# Altium schematic sheet fpga-rx.SchDoc
size D; CompanyName: Brinton Engineering, LLC; Address1: 3479 Edison Way; Address2: Menlo Park CA 94025; Address3: +1 (877) 778-8435; Address4: brintonengineering.com; DocumentNumber: 40; Revision: 1; SheetNumber: 40; SheetTotal: 50
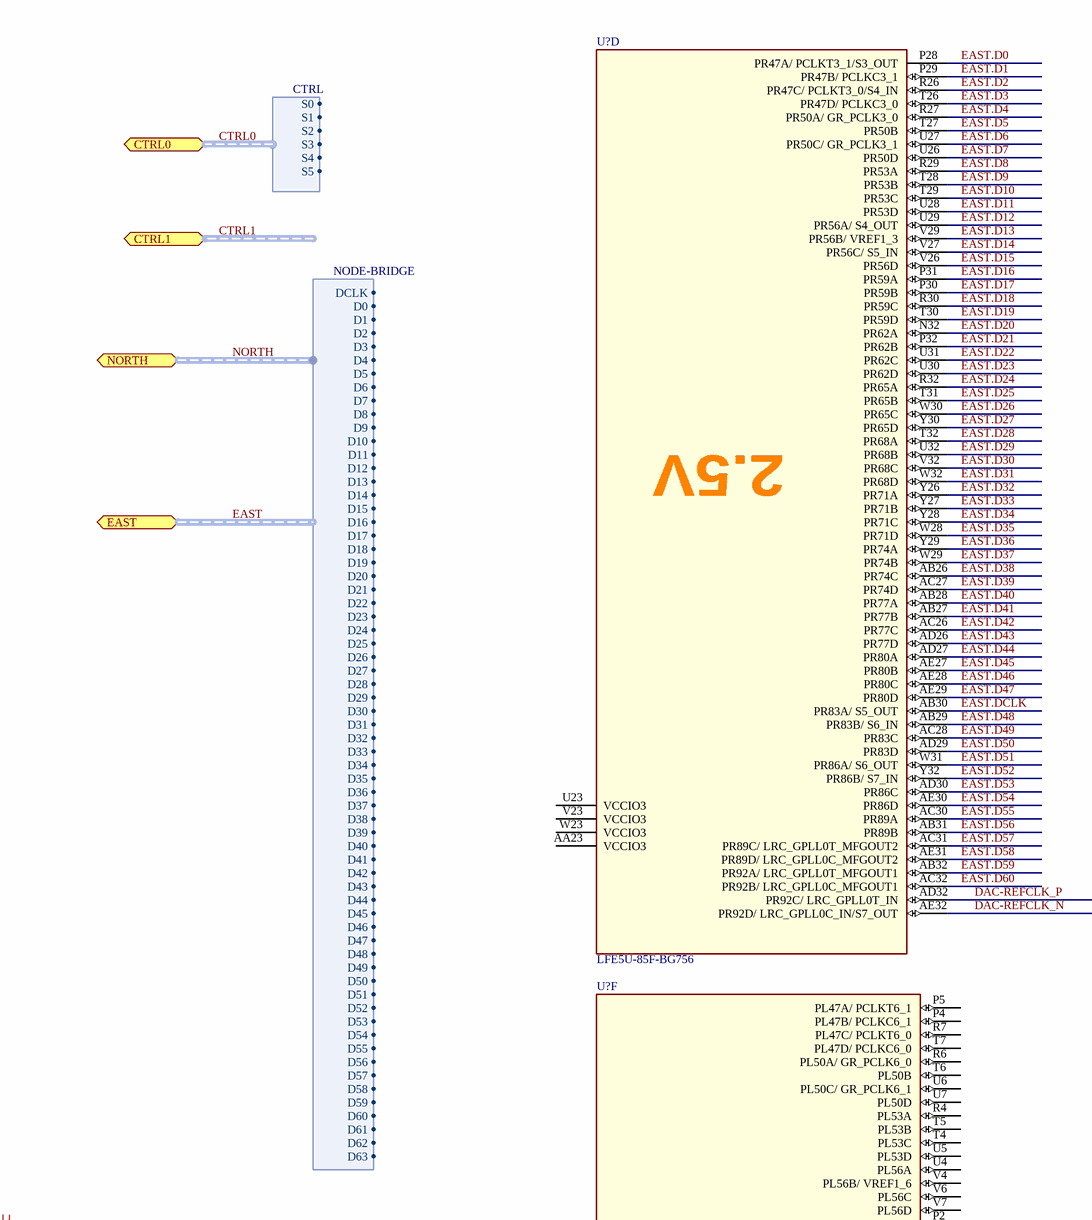
[diagram p0: fpga-rx.SchDoc, top left]
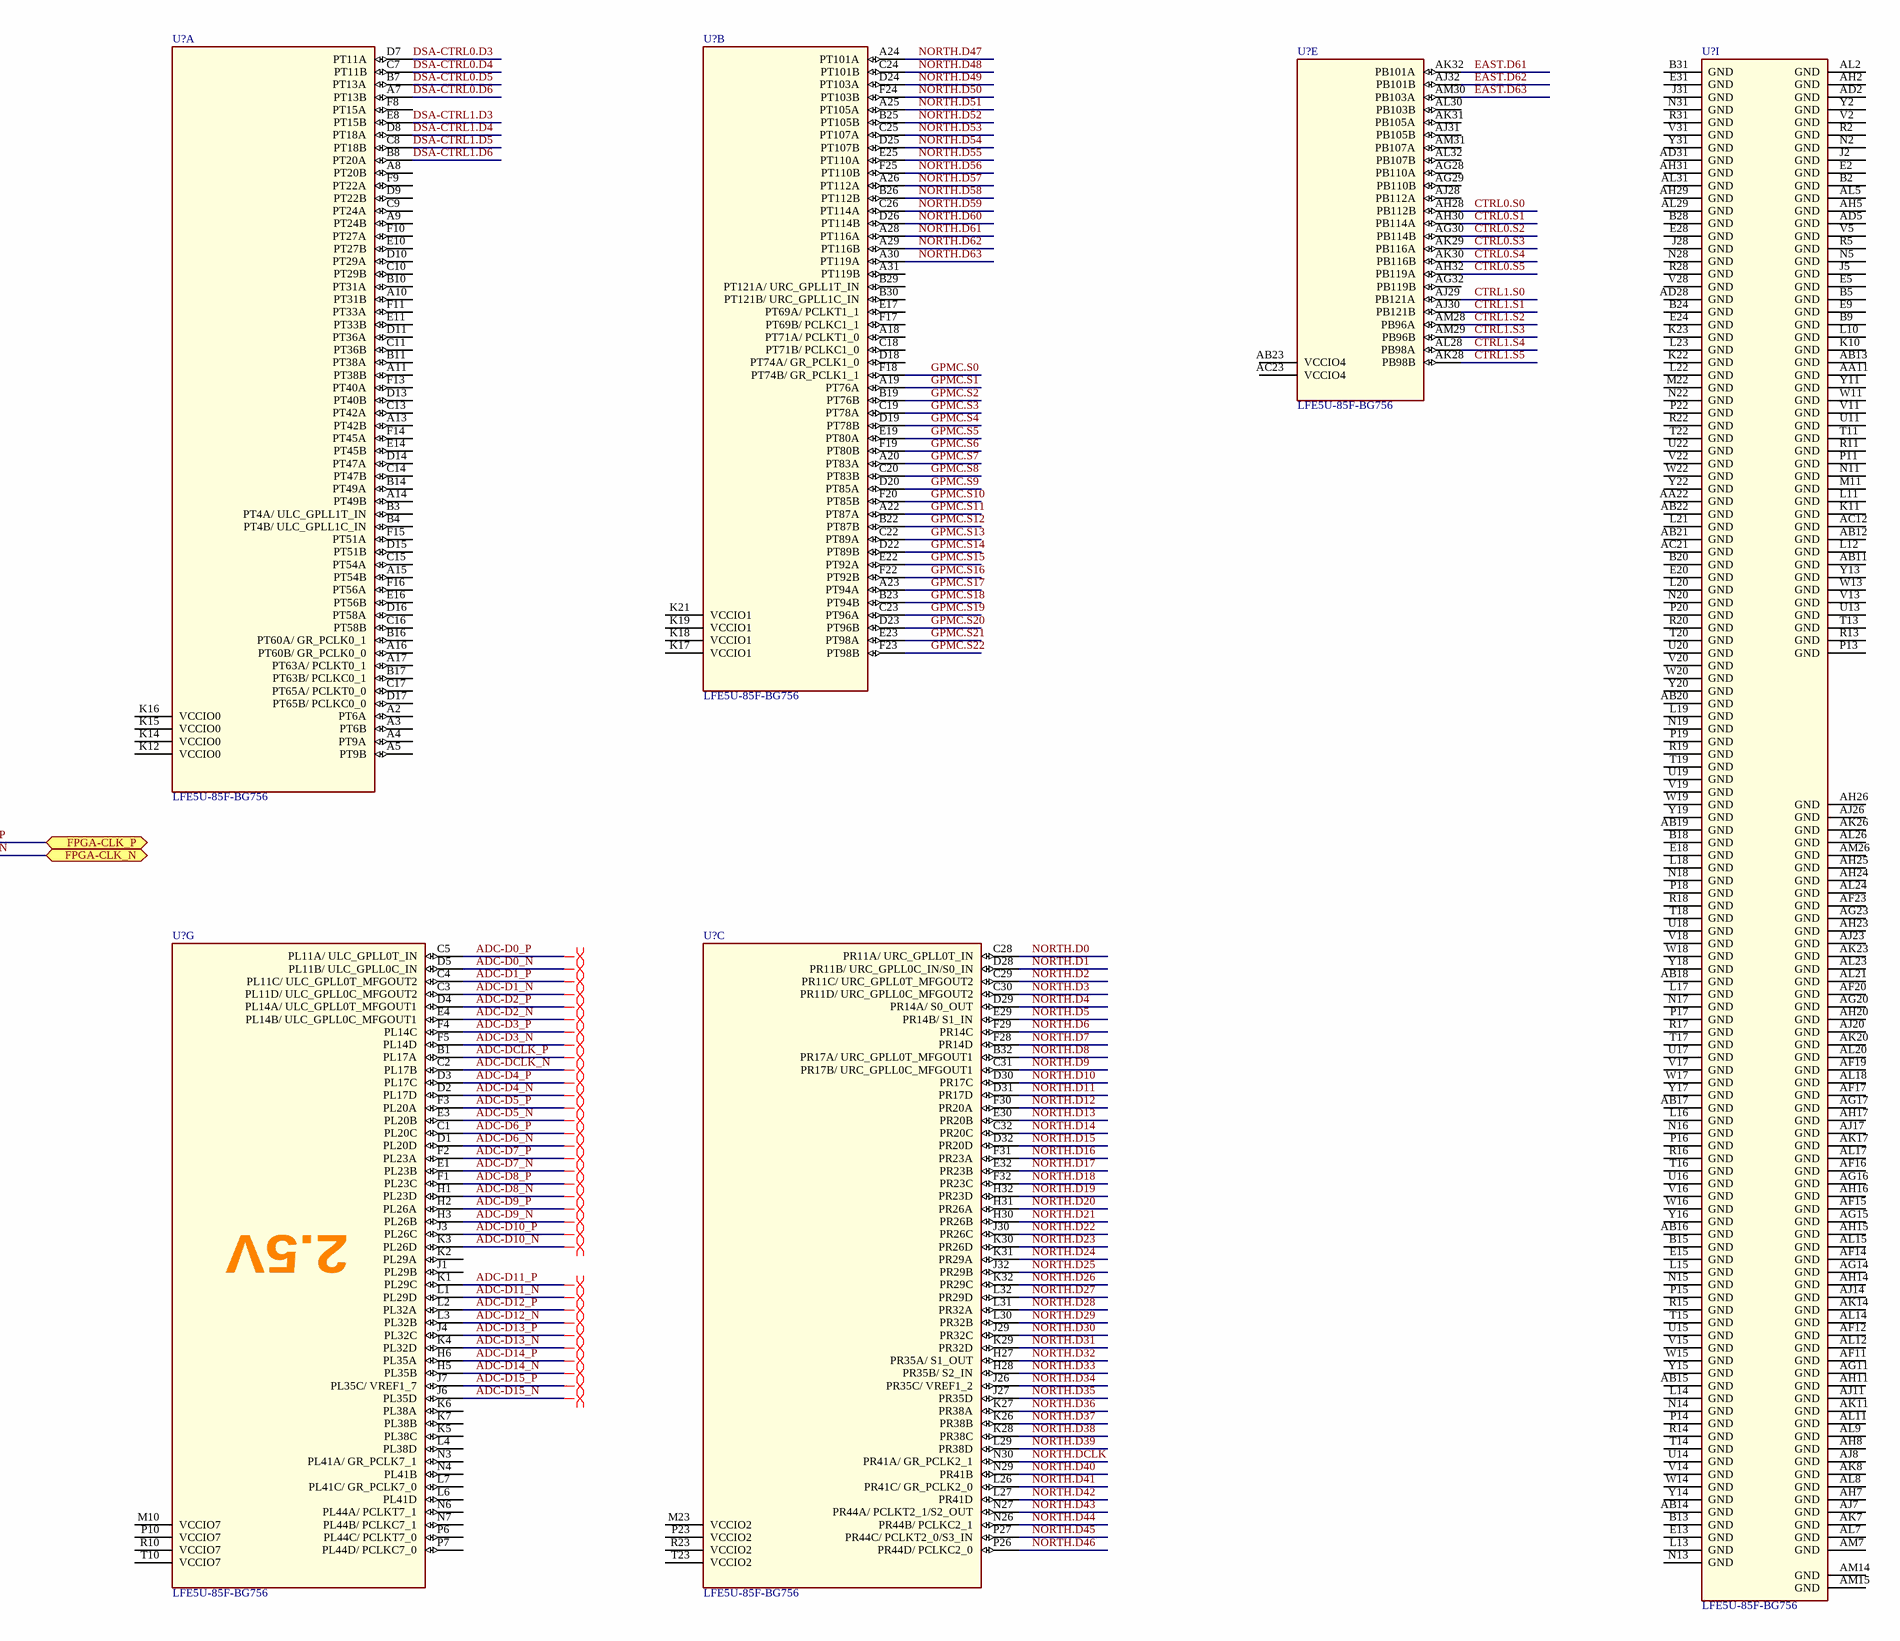
[diagram p1: fpga-rx.SchDoc, top right]
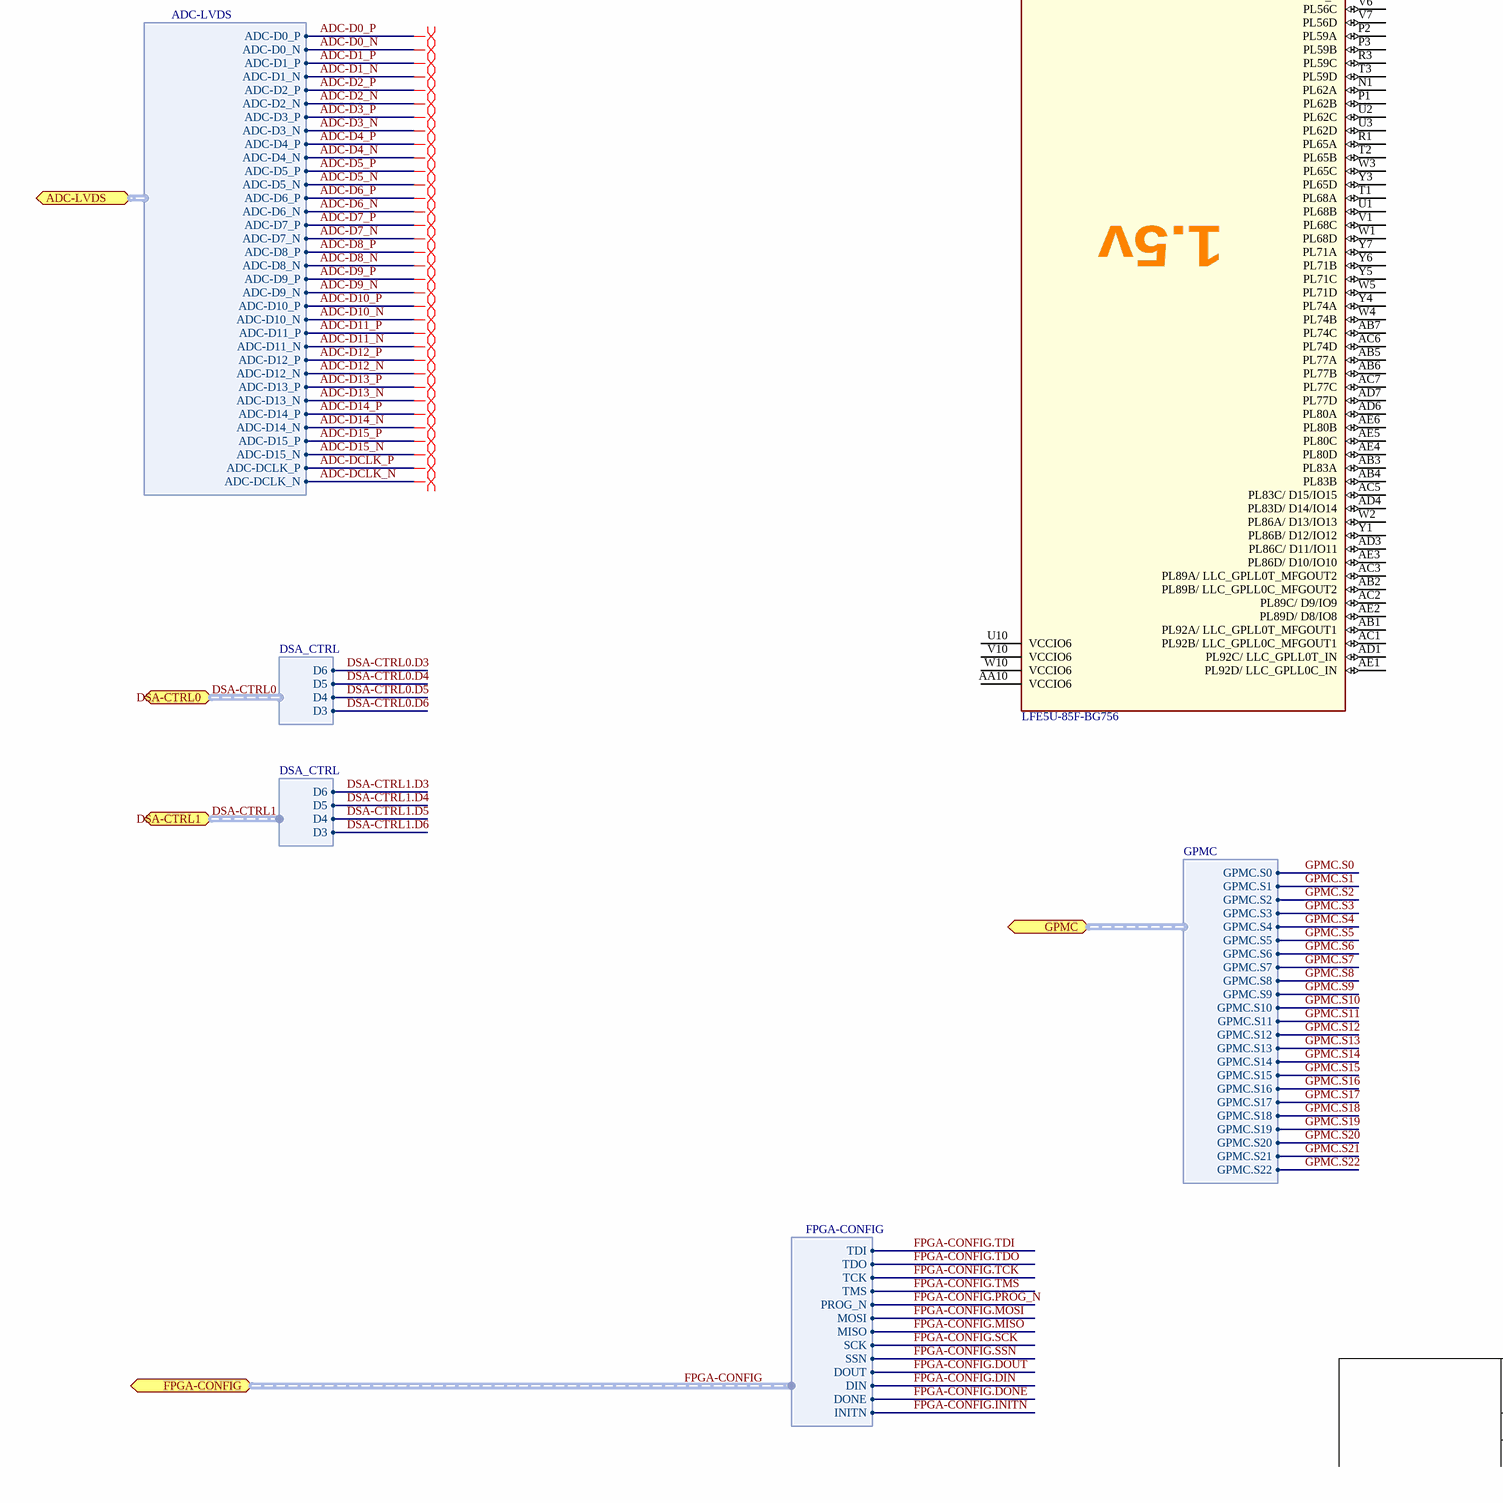
[diagram p2: fpga-rx.SchDoc, bottom left]
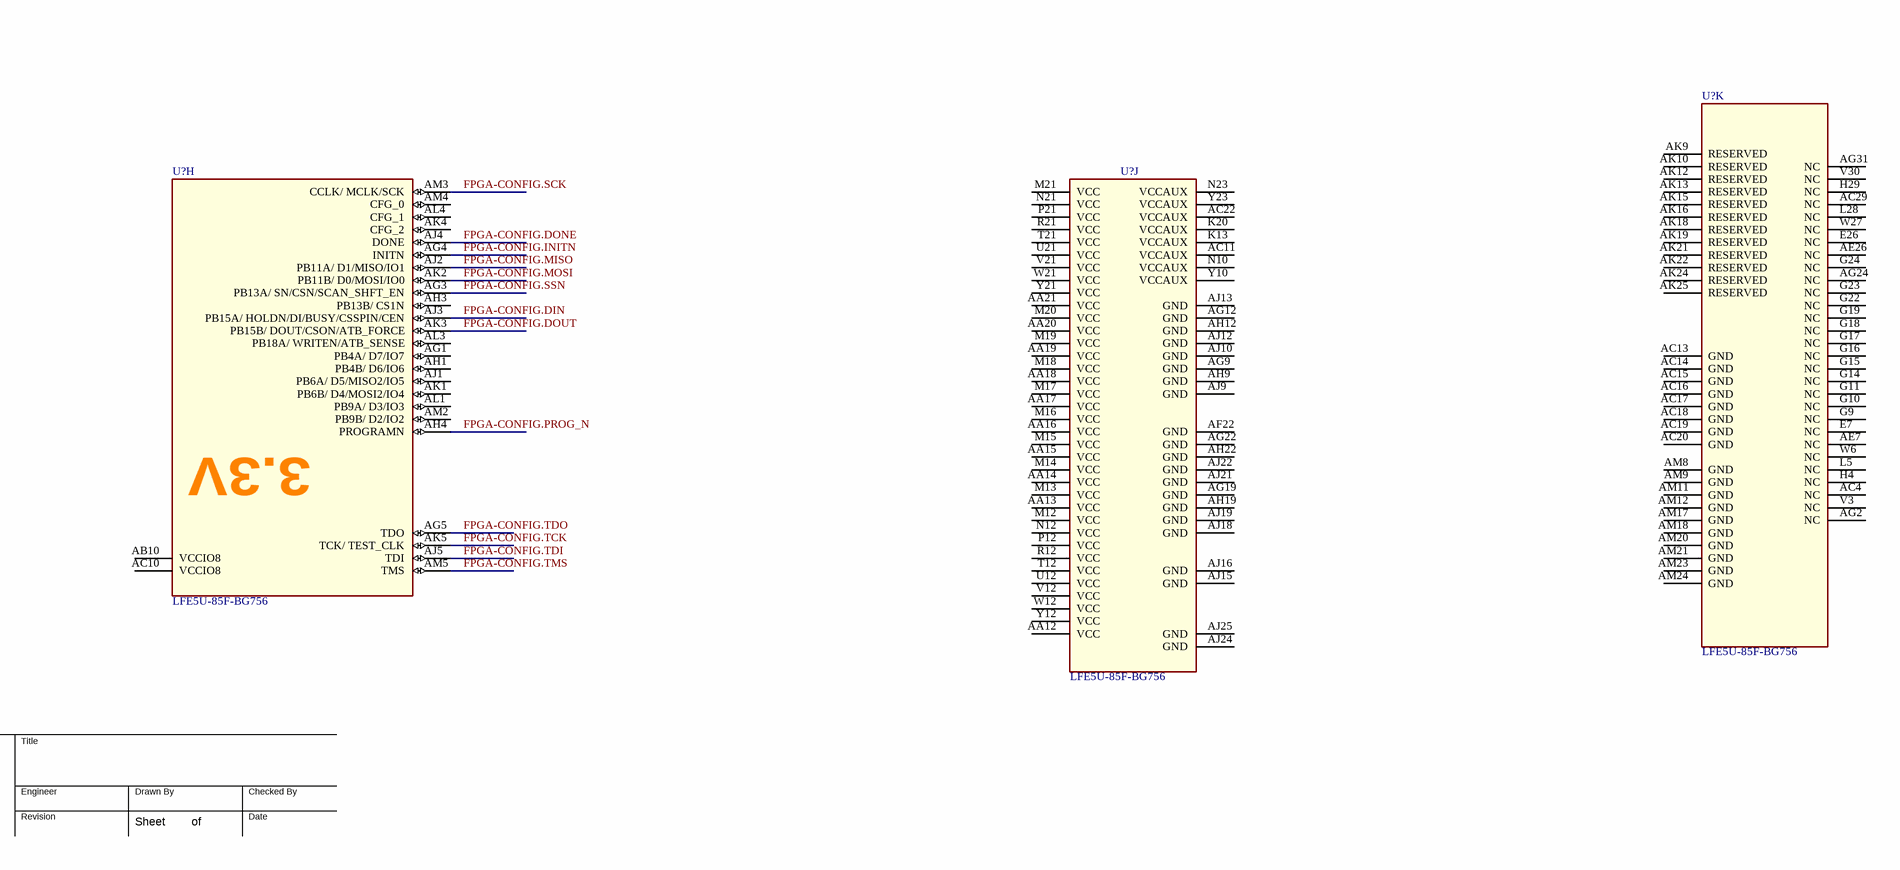
[diagram p3: fpga-rx.SchDoc, bottom right]

## Parts
(Parts that share a designator on the sheet are numbered #1, #2 ... from top to bottom, then left to right.)
U?#1  LFE5U-85F-BG756  (part D of 11)
U?#2  LFE5U-85F-BG756  (part A of 11)
U?#3  LFE5U-85F-BG756  (part B of 11)
U?#4  LFE5U-85F-BG756  (part E of 11)
U?#5  LFE5U-85F-BG756  (part I of 11)
U?#6  LFE5U-85F-BG756  (part F of 11)
U?#7  LFE5U-85F-BG756  (part G of 11)
U?#8  LFE5U-85F-BG756  (part C of 11)
U?#9  LFE5U-85F-BG756  (part K of 11)
U?#10  LFE5U-85F-BG756  (part H of 11)
U?#11  LFE5U-85F-BG756  (part J of 11)

## Ports
ADC-LVDS (harness ADC-LVDS), CTRL0 (harness CTRL), CTRL1 (harness CTRL), DSA-CTRL0 (harness DSA_CTRL), DSA-CTRL1 (harness DSA_CTRL), EAST (harness NODE-BRIDGE), FPGA-CLK_N, FPGA-CLK_P, FPGA-CONFIG (harness FPGA-CONFIG), GPMC (harness GPMC), NORTH (harness NODE-BRIDGE)

## Harnesses
ADC-LVDS: ADC-D0_P, ADC-D0_N, ADC-D1_P, ADC-D1_N, ADC-D2_P, ADC-D2_N, ADC-D3_P, ADC-D3_N, ADC-D4_P, ADC-D4_N, ADC-D5_P, ADC-D5_N, ADC-D6_P, ADC-D6_N, ADC-D7_P, ADC-D7_N, ADC-D8_P, ADC-D8_N, ADC-D9_P, ADC-D9_N, ADC-D10_P, ADC-D10_N, ADC-D11_P, ADC-D11_N, ADC-D12_P, ADC-D12_N, ADC-D13_P, ADC-D13_N, ADC-D14_P, ADC-D14_N, ADC-D15_P, ADC-D15_N, ADC-DCLK_P, ADC-DCLK_N
CTRL: S0, S1, S2, S3, S4, S5
NODE-BRIDGE: DCLK, D0, D1, D2, D3, D4, D5, D6, D7, D8, D9, D10, D11, D12, D13, D14, D15, D16, D17, D18, D19, D20, D21, D22, D23, D24, D25, D26, D27, D28, D29, D30, D31, D32, D33, D34, D35, D36, D37, D38, D39, D40, D41, D42, D43, D44, D45, D46, D47, D48, D49, D50, D51, D52, D53, D54, D55, D56, D57, D58, D59, D60, D61, D62, D63
GPMC: GPMC.S0, GPMC.S1, GPMC.S2, GPMC.S3, GPMC.S4, GPMC.S5, GPMC.S6, GPMC.S7, GPMC.S8, GPMC.S9, GPMC.S10, GPMC.S11, GPMC.S12, GPMC.S13, GPMC.S14, GPMC.S15, GPMC.S16, GPMC.S17, GPMC.S18, GPMC.S19, GPMC.S20, GPMC.S21, GPMC.S22
FPGA-CONFIG: SSN, SCK, MISO, MOSI, DOUT, DIN, DONE, INITN, TDI, TDO, TCK, TMS, PROG_N
DSA_CTRL: D3, D4, D5, D6

## Nets
ADC-D0_N: U?#7.D5(PL11B/_ULC_GPLL0C_IN) ; port ADC-LVDS.ADC-D0_N
ADC-D0_P: U?#7.C5(PL11A/_ULC_GPLL0T_IN) ; port ADC-LVDS.ADC-D0_P
ADC-D1_N: U?#7.C3(PL11D/_ULC_GPLL0C_MFGOUT2) ; port ADC-LVDS.ADC-D1_N
ADC-D1_P: U?#7.C4(PL11C/_ULC_GPLL0T_MFGOUT2) ; port ADC-LVDS.ADC-D1_P
ADC-D2_N: U?#7.E4(PL14B/_ULC_GPLL0C_MFGOUT1) ; port ADC-LVDS.ADC-D2_N
ADC-D2_P: U?#7.D4(PL14A/_ULC_GPLL0T_MFGOUT1) ; port ADC-LVDS.ADC-D2_P
ADC-D3_N: U?#7.F5(PL14D) ; port ADC-LVDS.ADC-D3_N
ADC-D3_P: U?#7.F4(PL14C) ; port ADC-LVDS.ADC-D3_P
ADC-D4_N: U?#7.D2(PL17D) ; port ADC-LVDS.ADC-D4_N
ADC-D4_P: U?#7.D3(PL17C) ; port ADC-LVDS.ADC-D4_P
ADC-D5_N: U?#7.E3(PL20B) ; port ADC-LVDS.ADC-D5_N
ADC-D5_P: U?#7.F3(PL20A) ; port ADC-LVDS.ADC-D5_P
ADC-D6_N: U?#7.D1(PL20D) ; port ADC-LVDS.ADC-D6_N
ADC-D6_P: U?#7.C1(PL20C) ; port ADC-LVDS.ADC-D6_P
ADC-D7_N: U?#7.E1(PL23B) ; port ADC-LVDS.ADC-D7_N
ADC-D7_P: U?#7.F2(PL23A) ; port ADC-LVDS.ADC-D7_P
ADC-D8_N: U?#7.H1(PL23D) ; port ADC-LVDS.ADC-D8_N
ADC-D8_P: U?#7.F1(PL23C) ; port ADC-LVDS.ADC-D8_P
ADC-D9_N: U?#7.H3(PL26B) ; port ADC-LVDS.ADC-D9_N
ADC-D9_P: U?#7.H2(PL26A) ; port ADC-LVDS.ADC-D9_P
ADC-D10_N: U?#7.K3(PL26D) ; port ADC-LVDS.ADC-D10_N
ADC-D10_P: U?#7.J3(PL26C) ; port ADC-LVDS.ADC-D10_P
ADC-D11_N: U?#7.L1(PL29D) ; port ADC-LVDS.ADC-D11_N
ADC-D11_P: U?#7.K1(PL29C) ; port ADC-LVDS.ADC-D11_P
ADC-D12_N: U?#7.L3(PL32B) ; port ADC-LVDS.ADC-D12_N
ADC-D12_P: U?#7.L2(PL32A) ; port ADC-LVDS.ADC-D12_P
ADC-D13_N: U?#7.K4(PL32D) ; port ADC-LVDS.ADC-D13_N
ADC-D13_P: U?#7.J4(PL32C) ; port ADC-LVDS.ADC-D13_P
ADC-D14_N: U?#7.H5(PL35B) ; port ADC-LVDS.ADC-D14_N
ADC-D14_P: U?#7.H6(PL35A) ; port ADC-LVDS.ADC-D14_P
ADC-D15_N: U?#7.J6(PL35D) ; port ADC-LVDS.ADC-D15_N
ADC-D15_P: U?#7.J7(PL35C/_VREF1_7) ; port ADC-LVDS.ADC-D15_P
ADC-DCLK_N: U?#7.C2(PL17B) ; port ADC-LVDS.ADC-DCLK_N
ADC-DCLK_P: U?#7.B1(PL17A) ; port ADC-LVDS.ADC-DCLK_P
CTRL0.S0: U?#4.AH28(PB112B)
CTRL0.S1: U?#4.AH30(PB114A)
CTRL0.S2: U?#4.AG30(PB114B)
CTRL0.S3: U?#4.AK29(PB116A)
CTRL0.S4: U?#4.AK30(PB116B)
CTRL0.S5: U?#4.AH32(PB119A)
CTRL1.S0: U?#4.AJ29(PB121A)
CTRL1.S1: U?#4.AJ30(PB121B)
CTRL1.S2: U?#4.AM28(PB96A)
CTRL1.S3: U?#4.AM29(PB96B)
CTRL1.S4: U?#4.AL28(PB98A)
CTRL1.S5: U?#4.AK28(PB98B)
DAC-REFCLK_N: U?#1.AE32(PR92D/_LRC_GPLL0C_IN/S7_OUT) ; port FPGA-CLK_N
DAC-REFCLK_P: U?#1.AD32(PR92C/_LRC_GPLL0T_IN) ; port FPGA-CLK_P
DSA-CTRL0.D3: U?#2.D7(PT11A) ; port DSA-CTRL0.D6
DSA-CTRL0.D4: U?#2.C7(PT11B) ; port DSA-CTRL0.D5
DSA-CTRL0.D5: U?#2.B7(PT13A) ; port DSA-CTRL0.D4  [project net DSA-CTRL0.D4]
DSA-CTRL0.D6: U?#2.A7(PT13B) ; port DSA-CTRL0.D3  [project net DSA-CTRL0.D3]
DSA-CTRL1.D3: U?#2.E8(PT15B) ; port DSA-CTRL1.D6
DSA-CTRL1.D4: U?#2.D8(PT18A) ; port DSA-CTRL1.D5
DSA-CTRL1.D5: U?#2.C8(PT18B) ; port DSA-CTRL1.D4  [project net DSA-CTRL1.D4]
DSA-CTRL1.D6: U?#2.B8(PT20A) ; port DSA-CTRL1.D3  [project net DSA-CTRL1.D3]
EAST.D0: U?#1.P28(PR47A/_PCLKT3_1/S3_OUT)
EAST.D1: U?#1.P29(PR47B/_PCLKC3_1)
EAST.D2: U?#1.R26(PR47C/_PCLKT3_0/S4_IN)
EAST.D3: U?#1.T26(PR47D/_PCLKC3_0)
EAST.D4: U?#1.R27(PR50A/_GR_PCLK3_0)
EAST.D5: U?#1.T27(PR50B)
EAST.D6: U?#1.U27(PR50C/_GR_PCLK3_1)
EAST.D7: U?#1.U26(PR50D)
EAST.D8: U?#1.R29(PR53A)
EAST.D9: U?#1.T28(PR53B)
EAST.D10: U?#1.T29(PR53C)
EAST.D11: U?#1.U28(PR53D)
EAST.D12: U?#1.U29(PR56A/_S4_OUT)
EAST.D13: U?#1.V29(PR56B/_VREF1_3)
EAST.D14: U?#1.V27(PR56C/_S5_IN)
EAST.D15: U?#1.V26(PR56D)
EAST.D16: U?#1.P31(PR59A)
EAST.D17: U?#1.P30(PR59B)
EAST.D18: U?#1.R30(PR59C)
EAST.D19: U?#1.T30(PR59D)
EAST.D20: U?#1.N32(PR62A)
EAST.D21: U?#1.P32(PR62B)
EAST.D22: U?#1.U31(PR62C)
EAST.D23: U?#1.U30(PR62D)
EAST.D24: U?#1.R32(PR65A)
EAST.D25: U?#1.T31(PR65B)
EAST.D26: U?#1.W30(PR65C)
EAST.D27: U?#1.Y30(PR65D)
EAST.D28: U?#1.T32(PR68A)
EAST.D29: U?#1.U32(PR68B)
EAST.D30: U?#1.V32(PR68C)
EAST.D31: U?#1.W32(PR68D)
EAST.D32: U?#1.Y26(PR71A)
EAST.D33: U?#1.Y27(PR71B)
EAST.D34: U?#1.Y28(PR71C)
EAST.D35: U?#1.W28(PR71D)
EAST.D36: U?#1.Y29(PR74A)
EAST.D37: U?#1.W29(PR74B)
EAST.D38: U?#1.AB26(PR74C)
EAST.D39: U?#1.AC27(PR74D)
EAST.D40: U?#1.AB28(PR77A)
EAST.D41: U?#1.AB27(PR77B)
EAST.D42: U?#1.AC26(PR77C)
EAST.D43: U?#1.AD26(PR77D)
EAST.D44: U?#1.AD27(PR80A)
EAST.D45: U?#1.AE27(PR80B)
EAST.D46: U?#1.AE28(PR80C)
EAST.D47: U?#1.AE29(PR80D)
EAST.D48: U?#1.AB29(PR83B/_S6_IN)
EAST.D49: U?#1.AC28(PR83C)
EAST.D50: U?#1.AD29(PR83D)
EAST.D51: U?#1.W31(PR86A/_S6_OUT)
EAST.D52: U?#1.Y32(PR86B/_S7_IN)
EAST.D53: U?#1.AD30(PR86C)
EAST.D54: U?#1.AE30(PR86D)
EAST.D55: U?#1.AC30(PR89A)
EAST.D56: U?#1.AB31(PR89B)
EAST.D57: U?#1.AC31(PR89C/_LRC_GPLL0T_MFGOUT2)
EAST.D58: U?#1.AE31(PR89D/_LRC_GPLL0C_MFGOUT2)
EAST.D59: U?#1.AB32(PR92A/_LRC_GPLL0T_MFGOUT1)
EAST.D60: U?#1.AC32(PR92B/_LRC_GPLL0C_MFGOUT1)
EAST.D61: U?#4.AK32(PB101A)
EAST.D62: U?#4.AJ32(PB101B)
EAST.D63: U?#4.AM30(PB103A)
EAST.DCLK: U?#1.AB30(PR83A/_S5_OUT)
FPGA-CONFIG.DIN: U?#10.AJ3(PB15A/_HOLDN/DI/BUSY/CSSPIN/CEN) ; port FPGA-CONFIG.DIN
FPGA-CONFIG.DONE: U?#10.AJ4(DONE) ; port FPGA-CONFIG.DONE
FPGA-CONFIG.DOUT: U?#10.AK3(PB15B/_DOUT/CSON/ATB_FORCE) ; port FPGA-CONFIG.DOUT
FPGA-CONFIG.INITN: U?#10.AG4(INITN) ; port FPGA-CONFIG.INITN
FPGA-CONFIG.MISO: U?#10.AJ2(PB11A/_D1/MISO/IO1) ; port FPGA-CONFIG.MISO
FPGA-CONFIG.MOSI: U?#10.AK2(PB11B/_D0/MOSI/IO0) ; port FPGA-CONFIG.MOSI
FPGA-CONFIG.PROG_N: U?#10.AH4(PROGRAMN) ; port FPGA-CONFIG.PROG_N
FPGA-CONFIG.SCK: U?#10.AM3(CCLK/_MCLK/SCK) ; port FPGA-CONFIG.SCK
FPGA-CONFIG.SSN: U?#10.AG3(PB13A/_SN/CSN/SCAN_SHFT_EN) ; port FPGA-CONFIG.SSN
FPGA-CONFIG.TCK: U?#10.AK5(TCK/_TEST_CLK) ; port FPGA-CONFIG.TCK
FPGA-CONFIG.TDI: U?#10.AJ5(TDI) ; port FPGA-CONFIG.TDI
FPGA-CONFIG.TDO: U?#10.AG5(TDO) ; port FPGA-CONFIG.TDO
FPGA-CONFIG.TMS: U?#10.AM5(TMS) ; port FPGA-CONFIG.TMS
GPMC.S0: U?#3.F18(PT74B/_GR_PCLK1_1) ; port GPMC.GPMC.S0
GPMC.S1: U?#3.A19(PT76A) ; port GPMC.GPMC.S1
GPMC.S2: U?#3.B19(PT76B) ; port GPMC.GPMC.S2
GPMC.S3: U?#3.C19(PT78A) ; port GPMC.GPMC.S3
GPMC.S4: U?#3.D19(PT78B) ; port GPMC.GPMC.S4
GPMC.S5: U?#3.E19(PT80A) ; port GPMC.GPMC.S5
GPMC.S6: U?#3.F19(PT80B) ; port GPMC.GPMC.S6
GPMC.S7: U?#3.A20(PT83A) ; port GPMC.GPMC.S7
GPMC.S8: U?#3.C20(PT83B) ; port GPMC.GPMC.S8
GPMC.S9: U?#3.D20(PT85A) ; port GPMC.GPMC.S9
GPMC.S10: U?#3.F20(PT85B) ; port GPMC.GPMC.S10
GPMC.S11: U?#3.A22(PT87A) ; port GPMC.GPMC.S11
GPMC.S12: U?#3.B22(PT87B) ; port GPMC.GPMC.S12
GPMC.S13: U?#3.C22(PT89A) ; port GPMC.GPMC.S13
GPMC.S14: U?#3.D22(PT89B) ; port GPMC.GPMC.S14
GPMC.S15: U?#3.E22(PT92A) ; port GPMC.GPMC.S15
GPMC.S16: U?#3.F22(PT92B) ; port GPMC.GPMC.S16
GPMC.S17: U?#3.A23(PT94A) ; port GPMC.GPMC.S17
GPMC.S18: U?#3.B23(PT94B) ; port GPMC.GPMC.S18
GPMC.S19: U?#3.C23(PT96A) ; port GPMC.GPMC.S19
GPMC.S20: U?#3.D23(PT96B) ; port GPMC.GPMC.S20
GPMC.S21: U?#3.E23(PT98A) ; port GPMC.GPMC.S21
GPMC.S22: U?#3.F23(PT98B) ; port GPMC.GPMC.S22
NORTH.D0: U?#8.C28(PR11A/_URC_GPLL0T_IN)
NORTH.D1: U?#8.D28(PR11B/_URC_GPLL0C_IN/S0_IN)
NORTH.D2: U?#8.C29(PR11C/_URC_GPLL0T_MFGOUT2)
NORTH.D3: U?#8.C30(PR11D/_URC_GPLL0C_MFGOUT2)
NORTH.D4: U?#8.D29(PR14A/_S0_OUT)
NORTH.D5: U?#8.E29(PR14B/_S1_IN)
NORTH.D6: U?#8.F29(PR14C)
NORTH.D7: U?#8.F28(PR14D)
NORTH.D8: U?#8.B32(PR17A/_URC_GPLL0T_MFGOUT1)
NORTH.D9: U?#8.C31(PR17B/_URC_GPLL0C_MFGOUT1)
NORTH.D10: U?#8.D30(PR17C)
NORTH.D11: U?#8.D31(PR17D)
NORTH.D12: U?#8.F30(PR20A)
NORTH.D13: U?#8.E30(PR20B)
NORTH.D14: U?#8.C32(PR20C)
NORTH.D15: U?#8.D32(PR20D)
NORTH.D16: U?#8.F31(PR23A)
NORTH.D17: U?#8.E32(PR23B)
NORTH.D18: U?#8.F32(PR23C)
NORTH.D19: U?#8.H32(PR23D)
NORTH.D20: U?#8.H31(PR26A)
NORTH.D21: U?#8.H30(PR26B)
NORTH.D22: U?#8.J30(PR26C)
NORTH.D23: U?#8.K30(PR26D)
NORTH.D24: U?#8.K31(PR29A)
NORTH.D25: U?#8.J32(PR29B)
NORTH.D26: U?#8.K32(PR29C)
NORTH.D27: U?#8.L32(PR29D)
NORTH.D28: U?#8.L31(PR32A)
NORTH.D29: U?#8.L30(PR32B)
NORTH.D30: U?#8.J29(PR32C)
NORTH.D31: U?#8.K29(PR32D)
NORTH.D32: U?#8.H27(PR35A/_S1_OUT)
NORTH.D33: U?#8.H28(PR35B/_S2_IN)
NORTH.D34: U?#8.J26(PR35C/_VREF1_2)
NORTH.D35: U?#8.J27(PR35D)
NORTH.D36: U?#8.K27(PR38A)
NORTH.D37: U?#8.K26(PR38B)
NORTH.D38: U?#8.K28(PR38C)
NORTH.D39: U?#8.L29(PR38D)
NORTH.D40: U?#8.N29(PR41B)
NORTH.D41: U?#8.L26(PR41C/_GR_PCLK2_0)
NORTH.D42: U?#8.L27(PR41D)
NORTH.D43: U?#8.N27(PR44A/_PCLKT2_1/S2_OUT)
NORTH.D44: U?#8.N26(PR44B/_PCLKC2_1)
NORTH.D45: U?#8.P27(PR44C/_PCLKT2_0/S3_IN)
NORTH.D46: U?#8.P26(PR44D/_PCLKC2_0)
NORTH.D47: U?#3.A24(PT101A)
NORTH.D48: U?#3.C24(PT101B)
NORTH.D49: U?#3.D24(PT103A)
NORTH.D50: U?#3.F24(PT103B)
NORTH.D51: U?#3.A25(PT105A)
NORTH.D52: U?#3.B25(PT105B)
NORTH.D53: U?#3.C25(PT107A)
NORTH.D54: U?#3.D25(PT107B)
NORTH.D55: U?#3.E25(PT110A)
NORTH.D56: U?#3.F25(PT110B)
NORTH.D57: U?#3.A26(PT112A)
NORTH.D58: U?#3.B26(PT112B)
NORTH.D59: U?#3.C26(PT114A)
NORTH.D60: U?#3.D26(PT114B)
NORTH.D61: U?#3.A28(PT116A)
NORTH.D62: U?#3.A29(PT116B)
NORTH.D63: U?#3.A30(PT119A)
NORTH.DCLK: U?#8.N30(PR41A/_GR_PCLK2_1)

Not connected (* = marked no-connect by the designer): U?#1 AA23(VCCIO3) U23(VCCIO3) V23(VCCIO3) W23(VCCIO3); U?#2 A2(PT6A) A3(PT6B) A4(PT9A) A5(PT9B) A8(PT20B) A9(PT24B) A10(PT31B) A11(PT38B) A13(PT42B) A14(PT49B) A15(PT54B) A16(PT60B/_GR_PCLK0_0) A17(PT63A/_PCLKT0_1) B3(PT4A/_ULC_GPLL1T_IN) B4(PT4B/_ULC_GPLL1C_IN) B10(PT31A) B11(PT38A) B14(PT49A) B16(PT60A/_GR_PCLK0_1) B17(PT63B/_PCLKC0_1) C9(PT24A) C10(PT29B) C11(PT36B) C13(PT42A) C14(PT47B) C15(PT54A) C16(PT58B) C17(PT65A/_PCLKT0_0) D9(PT22B) D10(PT29A) D11(PT36A) D13(PT40B) D14(PT47A) D15(PT51B) D16(PT58A) D17(PT65B/_PCLKC0_0) E10(PT27B) E11(PT33B) E14(PT45B) E16(PT56B) F8(PT15A) F9(PT22A) F10(PT27A) F11(PT33A) F13(PT40A) F14(PT45A) F15(PT51A) F16(PT56A) K12(VCCIO0) K14(VCCIO0) K15(VCCIO0) K16(VCCIO0); U?#3 A18(PT71A/_PCLKT1_0) A31(PT119B) B29(PT121A/_URC_GPLL1T_IN) B30(PT121B/_URC_GPLL1C_IN) C18(PT71B/_PCLKC1_0) D18(PT74A/_GR_PCLK1_0) E17(PT69A/_PCLKT1_1) F17(PT69B/_PCLKC1_1) K17(VCCIO1) K18(VCCIO1) K19(VCCIO1) K21(VCCIO1); U?#4 AB23(VCCIO4) AC23(VCCIO4) AG28(PB110A) AG29(PB110B) AG32(PB119B) AJ28(PB112A) AJ31(PB105B) AK31(PB105A) AL30(PB103B) AL32(PB107B) AM31(PB107A); U?#5 AA11(GND) AA22(GND) AB11(GND) AB12(GND) AB13(GND) AB14(GND) AB15(GND) AB16(GND) AB17(GND) AB18(GND) AB19(GND) AB20(GND) AB21(GND) AB22(GND) AC12(GND) AC21(GND) AD2(GND) AD5(GND) AD28(GND) AD31(GND) AF11(GND) AF12(GND) AF14(GND) AF15(GND) AF16(GND) AF17(GND) AF19(GND) AF20(GND) AF23(GND) AG11(GND) AG14(GND) AG15(GND) AG16(GND) AG17(GND) AG20(GND) AG23(GND) AH2(GND) AH5(GND) AH7(GND) AH8(GND) AH11(GND) AH14(GND) AH15(GND) AH16(GND) AH17(GND) AH20(GND) AH23(GND) AH24(GND) AH25(GND) AH26(GND) AH29(GND) AH31(GND) AJ7(GND) AJ8(GND) AJ11(GND) AJ14(GND) AJ17(GND) AJ20(GND) AJ23(GND) AJ26(GND) AK7(GND) AK8(GND) AK11(GND) AK14(GND) AK17(GND) AK20(GND) AK23(GND) AK26(GND) AL2(GND) AL5(GND) AL7(GND) AL8(GND) AL9(GND) AL11(GND) AL12(GND) AL14(GND) AL15(GND) AL17(GND) AL18(GND) AL20(GND) AL21(GND) AL23(GND) AL24(GND) AL26(GND) AL29(GND) AL31(GND) AM7(GND) AM14(GND) AM15(GND) AM26(GND) B2(GND) B5(GND) B9(GND) B13(GND) B15(GND) B18(GND) B20(GND) B24(GND) B28(GND) B31(GND) E2(GND) E5(GND) E9(GND) E13(GND) E15(GND) E18(GND) E20(GND) E24(GND) E28(GND) E31(GND) J2(GND) J5(GND) J28(GND) J31(GND) K10(GND) K11(GND) K22(GND) K23(GND) L10(GND) L11(GND) L12(GND) L13(GND) L14(GND) L15(GND) L16(GND) L17(GND) L18(GND) L19(GND) L20(GND) L21(GND) L22(GND) L23(GND) M11(GND) M22(GND) N2(GND) N5(GND) N11(GND) N13(GND) N14(GND) N15(GND) N16(GND) N17(GND) N18(GND) N19(GND) N20(GND) N22(GND) N28(GND) N31(GND) P11(GND) P13(GND) P14(GND) P15(GND) P16(GND) P17(GND) P18(GND) P19(GND) P20(GND) P22(GND) R2(GND) R5(GND) R11(GND) R13(GND) R14(GND) R15(GND) R16(GND) R17(GND) R18(GND) R19(GND) R20(GND) R22(GND) R28(GND) R31(GND) T11(GND) T13(GND) T14(GND) T15(GND) T16(GND) T17(GND) T18(GND) T19(GND) T20(GND) T22(GND) U11(GND) U13(GND) U14(GND) U15(GND) U16(GND) U17(GND) U18(GND) U19(GND) U20(GND) U22(GND) V2(GND) V5(GND) V11(GND) V13(GND) V14(GND) V15(GND) V16(GND) V17(GND) V18(GND) V19(GND) V20(GND) V22(GND) V28(GND) V31(GND) W11(GND) W13(GND) W14(GND) W15(GND) W16(GND) W17(GND) W18(GND) W19(GND) W20(GND) W22(GND) Y2(GND) Y11(GND) Y13(GND) Y14(GND) Y15(GND) Y16(GND) Y17(GND) Y18(GND) Y19(GND) Y20(GND) Y22(GND) Y31(GND); U?#6 AA10(VCCIO6) AB1(PL92A/_LLC_GPLL0T_MFGOUT1) AB2(PL89B/_LLC_GPLL0C_MFGOUT2) AB3(PL83A) AB4(PL83B) AB5(PL77A) AB6(PL77B) AB7(PL74C) AC1(PL92B/_LLC_GPLL0C_MFGOUT1) AC2(PL89C/_D9/IO9) AC3(PL89A/_LLC_GPLL0T_MFGOUT2) AC5(PL83C/_D15/IO15) AC6(PL74D) AC7(PL77C) AD1(PL92C/_LLC_GPLL0T_IN) AD3(PL86C/_D11/IO11) AD4(PL83D/_D14/IO14) AD6(PL80A) AD7(PL77D) AE1(PL92D/_LLC_GPLL0C_IN) AE2(PL89D/_D8/IO8) AE3(PL86D/_D10/IO10) AE4(PL80D) AE5(PL80C) AE6(PL80B) N1(PL62A) P1(PL62B) P2(PL59A) P3(PL59B) P4(PL47B/_PCLKC6_1) P5(PL47A/_PCLKT6_1) R1(PL65A) R3(PL59C) R4(PL53A) R6(PL50A/_GR_PCLK6_0) R7(PL47C/_PCLKT6_0) T1(PL68A) T2(PL65B) T3(PL59D) T4(PL53C) T5(PL53B) T6(PL50B) T7(PL47D/_PCLKC6_0) U1(PL68B) U2(PL62C) U3(PL62D) U4(PL56A) U5(PL53D) U6(PL50C/_GR_PCLK6_1) U7(PL50D) U10(VCCIO6) V1(PL68C) V4(PL56B/_VREF1_6) V6(PL56C) V7(PL56D) V10(VCCIO6) W1(PL68D) W2(PL86A/_D13/IO13) W3(PL65C) W4(PL74B) W5(PL71D) W10(VCCIO6) Y1(PL86B/_D12/IO12) Y3(PL65D) Y4(PL74A) Y5(PL71C) Y6(PL71B) Y7(PL71A); U?#7 J1(PL29B) K2(PL29A) K5(PL38C) K6(PL38A) K7(PL38B) L4(PL38D) L6(PL41D) L7(PL41C/_GR_PCLK7_0) M10(VCCIO7) N3(PL41A/_GR_PCLK7_1) N4(PL41B) N6(PL44A/_PCLKT7_1) N7(PL44B/_PCLKC7_1) P6(PL44C/_PCLKT7_0) P7(PL44D/_PCLKC7_0) P10(VCCIO7) R10(VCCIO7) T10(VCCIO7); U?#8 M23(VCCIO2) P23(VCCIO2) R23(VCCIO2) T23(VCCIO2); U?#9 AC4(NC) AC13(GND) AC14(GND) AC15(GND) AC16(GND) AC17(GND) AC18(GND) AC19(GND) AC20(GND) AC29(NC) AE7(NC) AE26(NC) AG2(NC) AG24(NC) AG31(NC) AK9(RESERVED) AK10(RESERVED) AK12(RESERVED) AK13(RESERVED) AK15(RESERVED) AK16(RESERVED) AK18(RESERVED) AK19(RESERVED) AK21(RESERVED) AK22(RESERVED) AK24(RESERVED) AK25(RESERVED) AM8(GND) AM9(GND) AM11(GND) AM12(GND) AM17(GND) AM18(GND) AM20(GND) AM21(GND) AM23(GND) AM24(GND) E7(NC) E26(NC) G9(NC) G10(NC) G11(NC) G14(NC) G15(NC) G16(NC) G17(NC) G18(NC) G19(NC) G22(NC) G23(NC) G24(NC) H4(NC) H29(NC) L5(NC) L28(NC) V3(NC) V30(NC) W6(NC) W27(NC); U?#10 AB10(VCCIO8) AC10(VCCIO8) AG1(PB4A/_D7/IO7) AH1(PB4B/_D6/IO6) AH3(PB13B/_CS1N) AJ1(PB6A/_D5/MISO2/IO5) AK1(PB6B/_D4/MOSI2/IO4) AK4(CFG_2) AL1(PB9A/_D3/IO3) AL3(PB18A/_WRITEN/ATB_SENSE) AL4(CFG_1) AM2(PB9B/_D2/IO2) AM4(CFG_0); U?#11 AA12(VCC) AA13(VCC) AA14(VCC) AA15(VCC) AA16(VCC) AA17(VCC) AA18(VCC) AA19(VCC) AA20(VCC) AA21(VCC) AC11(VCCAUX) AC22(VCCAUX) AF22(GND) AG9(GND) AG12(GND) AG19(GND) AG22(GND) AH9(GND) AH12(GND) AH19(GND) AH22(GND) AJ9(GND) AJ10(GND) AJ12(GND) AJ13(GND) AJ15(GND) AJ16(GND) AJ18(GND) AJ19(GND) AJ21(GND) AJ22(GND) AJ24(GND) AJ25(GND) K13(VCCAUX) K20(VCCAUX) M12(VCC) M13(VCC) M14(VCC) M15(VCC) M16(VCC) M17(VCC) M18(VCC) M19(VCC) M20(VCC) M21(VCC) N10(VCCAUX) N12(VCC) N21(VCC) N23(VCCAUX) P12(VCC) P21(VCC) R12(VCC) R21(VCC) T12(VCC) T21(VCC) U12(VCC) U21(VCC) V12(VCC) V21(VCC) W12(VCC) W21(VCC) Y10(VCCAUX) Y12(VCC) Y21(VCC) Y23(VCCAUX)

## Buses and harness runs
harness CTRL0 = port CTRL0
harness CTRL1 = port CTRL1
harness DSA-CTRL0 = port DSA-CTRL0
harness DSA-CTRL1 = port DSA-CTRL1
harness EAST = port EAST
harness FPGA-CONFIG = port FPGA-CONFIG
harness NORTH = port NORTH

## Layout directives
differential pair: ADC-D0_N, ADC-D0_P, ADC-D1_N, ADC-D1_P, ADC-D2_N, ADC-D2_P, ADC-D3_N, ADC-D3_P, ADC-D4_N, ADC-D4_P, ADC-D5_N, ADC-D5_P, ADC-D6_N, ADC-D6_P, ADC-D7_N, ADC-D7_P, ADC-D8_N, ADC-D8_P, ADC-D9_N, ADC-D9_P, ADC-D10_N, ADC-D10_P, ADC-D11_N, ADC-D11_P, ADC-D12_N, ADC-D12_P, ADC-D13_N, ADC-D13_P, ADC-D14_N, ADC-D14_P, ADC-D15_N, ADC-D15_P, ADC-DCLK_N, ADC-DCLK_P

## Notes on the sheet
- (near U?#1) 2.5V
- (near U?#7) 2.5V
- (near U?#6) 1.5v
- (near U?#10) 3.3V
- Title
- Engineer
- Revision
- Drawn By
- Checked By
- Date
- Sheet
- of

## Library data of the parts
U?#1-U?#11 = LFE5U-85F-BG756: SWAP_INFO: (S1+S2+S3+S4+S5+S6+S7+S8+S9+S10+S11); SPLIT_INST: TRUE